# EAGLE board Resistor_Resistor (EAGLE 8.3.0), part 3 of 32 (continued)
## Placement (x,y rotation side) (continued)
R3281  10K  [0201]  44.86,50.04 0 top
R3282  10K  [0201]  44.86,50.65 0 top
R3283  10K  [0201]  44.86,51.26 0 top
R3284  10K  [0201]  44.86,51.87 0 top
R3285  10K  [0201]  44.86,52.48 0 top
R3286  10K  [0201]  44.86,53.09 0 top
R3287  10K  [0201]  44.86,53.7 0 top
R3288  10K  [0201]  44.86,54.31 0 top
R3289  10K  [0201]  44.86,54.91 0 top
R3290  10K  [0201]  44.86,55.52 0 top
R3291  10K  [0201]  44.86,56.13 0 top
R3292  10K  [0201]  44.86,56.74 0 top
R3293  10K  [0201]  44.86,57.35 0 top
R3294  10K  [0201]  44.86,57.96 0 top
R3295  10K  [0201]  44.86,58.57 0 top
R3296  10K  [0201]  44.86,59.18 0 top
R3297  10K  [0201]  44.86,59.79 0 top
R3298  10K  [0201]  44.86,60.4 0 top
R3299  10K  [0201]  44.86,61.01 0 top
R3300  10K  [0201]  44.86,61.62 0 top
R3301  10K  [0201]  44.86,62.23 0 top
R3302  10K  [0201]  44.86,62.84 0 top
R3303  10K  [0201]  44.86,63.45 0 top
R3304  10K  [0201]  44.86,64.06 0 top
R3305  10K  [0201]  44.86,64.67 0 top
R3306  10K  [0201]  44.86,65.28 0 top
R3307  10K  [0201]  44.86,65.89 0 top
R3308  10K  [0201]  44.86,66.5 0 top
R3309  10K  [0201]  44.86,67.11 0 top
R3310  10K  [0201]  44.86,67.72 0 top
R3311  10K  [0201]  44.86,68.33 0 top
R3312  10K  [0201]  44.86,68.94 0 top
R3313  10K  [0201]  44.86,69.55 0 top
R3314  10K  [0201]  44.86,70.15 0 top
R3315  10K  [0201]  44.86,70.76 0 top
R3316  10K  [0201]  44.86,71.37 0 top
R3317  10K  [0201]  44.86,71.98 0 top
R3318  10K  [0201]  44.86,72.59 0 top
R3319  10K  [0201]  44.86,73.2 0 top
R3320  10K  [0201]  44.86,73.81 0 top
R3321  10K  [0201]  44.86,74.42 0 top
R3322  10K  [0201]  44.86,75.03 0 top
R3323  10K  [0201]  44.86,75.64 0 top
R3324  10K  [0201]  44.86,76.25 0 top
R3325  10K  [0201]  44.86,76.86 0 top
R3326  10K  [0201]  44.86,77.47 0 top
R3327  10K  [0201]  44.86,78.08 0 top
R3328  10K  [0201]  44.86,78.69 0 top
R3329  10K  [0201]  44.86,79.3 0 top
R3330  10K  [0201]  44.86,79.91 0 top
R3331  10K  [0201]  44.86,80.52 0 top
R3332  10K  [0201]  44.86,81.13 0 top
R3333  10K  [0201]  44.86,81.74 0 top
R3334  10K  [0201]  44.86,82.35 0 top
R3335  10K  [0201]  44.86,82.96 0 top
R3336  10K  [0201]  44.86,83.57 0 top
R3337  10K  [0201]  44.86,84.18 0 top
R3338  10K  [0201]  44.86,84.79 0 top
R3339  10K  [0201]  44.86,85.39 0 top
R3340  10K  [0201]  44.86,86 0 top
R3341  10K  [0201]  44.86,86.61 0 top
R3342  10K  [0201]  44.86,87.22 0 top
R3343  10K  [0201]  44.86,87.83 0 top
R3344  10K  [0201]  44.86,88.44 0 top
R3345  10K  [0201]  44.86,89.05 0 top
R3346  10K  [0201]  44.86,89.66 0 top
R3347  10K  [0201]  44.86,90.27 0 top
R3348  10K  [0201]  44.86,90.88 0 top
R3349  10K  [0201]  44.86,91.49 0 top
R3350  10K  [0201]  44.86,92.1 0 top
R3351  10K  [0201]  44.86,92.71 0 top
R3352  10K  [0201]  44.86,93.32 0 top
R3353  10K  [0201]  44.86,93.93 0 top
R3354  10K  [0201]  44.86,94.54 0 top
R3355  10K  [0201]  44.86,95.15 0 top
R3356  10K  [0201]  44.86,95.76 0 top
R3357  10K  [0201]  44.86,96.37 0 top
R3358  10K  [0201]  44.86,96.98 0 top
R3359  10K  [0201]  44.86,97.59 0 top
R3360  10K  [0201]  44.86,98.2 0 top
R3361  10K  [0201]  44.86,98.81 0 top
R3362  10K  [0201]  44.86,99.42 0 top
R3363  10K  [0201]  44.86,100.03 0 top
R3364  10K  [0201]  44.86,100.63 0 top
R3365  10K  [0201]  44.86,101.24 0 top
R3366  10K  [0201]  44.86,101.85 0 top
R3367  10K  [0201]  44.86,102.46 0 top
R3368  10K  [0201]  44.86,103.07 0 top
R3369  10K  [0201]  44.86,103.68 0 top
R3370  10K  [0201]  44.86,104.29 0 top
R3371  10K  [0201]  44.86,104.9 0 top
R3372  10K  [0201]  44.86,105.51 0 top
R3373  10K  [0201]  44.86,106.12 0 top
R3374  10K  [0201]  44.86,106.73 0 top
R3375  10K  [0201]  44.86,107.34 0 top
R3376  10K  [0201]  44.86,107.95 0 top
R3377  10K  [0201]  44.86,108.56 0 top
R3378  10K  [0201]  44.86,109.17 0 top
R3379  10K  [0201]  44.86,109.78 0 top
R3380  10K  [0201]  44.86,110.39 0 top
R3381  10K  [0201]  44.86,111 0 top
R3382  10K  [0201]  44.86,111.61 0 top
R3383  10K  [0201]  44.86,112.22 0 top
R3384  10K  [0201]  44.86,112.83 0 top
R3385  10K  [0201]  44.86,113.44 0 top
R3386  10K  [0201]  44.86,114.05 0 top
R3387  10K  [0201]  44.86,114.66 0 top
R3388  10K  [0201]  44.86,115.27 0 top
R3389  10K  [0201]  44.86,115.87 0 top
R3390  10K  [0201]  44.86,116.48 0 top
R3391  10K  [0201]  44.86,117.09 0 top
R3392  10K  [0201]  44.86,117.7 0 top
R3393  10K  [0201]  44.86,118.31 0 top
R3394  10K  [0201]  44.86,118.92 0 top
R3395  10K  [0201]  44.86,119.53 0 top
R3396  10K  [0201]  44.86,120.14 0 top
R3397  10K  [0201]  44.86,120.75 0 top
R3398  10K  [0201]  44.86,121.36 0 top
R3399  10K  [0201]  44.86,121.97 0 top
R3400  10K  [0201]  44.86,122.58 0 top
R3401  10K  [0201]  46.08,1.27 0 top
R3402  10K  [0201]  46.08,1.88 0 top
R3403  10K  [0201]  46.08,2.49 0 top
R3404  10K  [0201]  46.08,3.1 0 top
R3405  10K  [0201]  46.08,3.71 0 top
R3406  10K  [0201]  46.08,4.32 0 top
R3407  10K  [0201]  46.08,4.93 0 top
R3408  10K  [0201]  46.08,5.54 0 top
R3409  10K  [0201]  46.08,6.15 0 top
R3410  10K  [0201]  46.08,6.76 0 top
R3411  10K  [0201]  46.08,7.37 0 top
R3412  10K  [0201]  46.08,7.98 0 top
R3413  10K  [0201]  46.08,8.59 0 top
R3414  10K  [0201]  46.08,9.19 0 top
R3415  10K  [0201]  46.08,9.8 0 top
R3416  10K  [0201]  46.08,10.41 0 top
R3417  10K  [0201]  46.08,11.02 0 top
R3418  10K  [0201]  46.08,11.63 0 top
R3419  10K  [0201]  46.08,12.24 0 top
R3420  10K  [0201]  46.08,12.85 0 top
R3421  10K  [0201]  46.08,13.46 0 top
R3422  10K  [0201]  46.08,14.07 0 top
R3423  10K  [0201]  46.08,14.68 0 top
R3424  10K  [0201]  46.08,15.29 0 top
R3425  10K  [0201]  46.08,15.9 0 top
R3426  10K  [0201]  46.08,16.51 0 top
R3427  10K  [0201]  46.08,17.12 0 top
R3428  10K  [0201]  46.08,17.73 0 top
R3429  10K  [0201]  46.08,18.34 0 top
R3430  10K  [0201]  46.08,18.95 0 top
R3431  10K  [0201]  46.08,19.56 0 top
R3432  10K  [0201]  46.08,20.17 0 top
R3433  10K  [0201]  46.08,20.78 0 top
R3434  10K  [0201]  46.08,21.39 0 top
R3435  10K  [0201]  46.08,22 0 top
R3436  10K  [0201]  46.08,22.61 0 top
R3437  10K  [0201]  46.08,23.22 0 top
R3438  10K  [0201]  46.08,23.83 0 top
R3439  10K  [0201]  46.08,24.43 0 top
R3440  10K  [0201]  46.08,25.04 0 top
R3441  10K  [0201]  46.08,25.65 0 top
R3442  10K  [0201]  46.08,26.26 0 top
R3443  10K  [0201]  46.08,26.87 0 top
R3444  10K  [0201]  46.08,27.48 0 top
R3445  10K  [0201]  46.08,28.09 0 top
R3446  10K  [0201]  46.08,28.7 0 top
R3447  10K  [0201]  46.08,29.31 0 top
R3448  10K  [0201]  46.08,29.92 0 top
R3449  10K  [0201]  46.08,30.53 0 top
R3450  10K  [0201]  46.08,31.14 0 top
R3451  10K  [0201]  46.08,31.75 0 top
R3452  10K  [0201]  46.08,32.36 0 top
R3453  10K  [0201]  46.08,32.97 0 top
R3454  10K  [0201]  46.08,33.58 0 top
R3455  10K  [0201]  46.08,34.19 0 top
R3456  10K  [0201]  46.08,34.8 0 top
R3457  10K  [0201]  46.08,35.41 0 top
R3458  10K  [0201]  46.08,36.02 0 top
R3459  10K  [0201]  46.08,36.63 0 top
R3460  10K  [0201]  46.08,37.24 0 top
R3461  10K  [0201]  46.08,37.85 0 top
R3462  10K  [0201]  46.08,38.46 0 top
R3463  10K  [0201]  46.08,39.07 0 top
R3464  10K  [0201]  46.08,39.67 0 top
R3465  10K  [0201]  46.08,40.28 0 top
R3466  10K  [0201]  46.08,40.89 0 top
R3467  10K  [0201]  46.08,41.5 0 top
R3468  10K  [0201]  46.08,42.11 0 top
R3469  10K  [0201]  46.08,42.72 0 top
R3470  10K  [0201]  46.08,43.33 0 top
R3471  10K  [0201]  46.08,43.94 0 top
R3472  10K  [0201]  46.08,44.55 0 top
R3473  10K  [0201]  46.08,45.16 0 top
R3474  10K  [0201]  46.08,45.77 0 top
R3475  10K  [0201]  46.08,46.38 0 top
R3476  10K  [0201]  46.08,46.99 0 top
R3477  10K  [0201]  46.08,47.6 0 top
R3478  10K  [0201]  46.08,48.21 0 top
R3479  10K  [0201]  46.08,48.82 0 top
R3480  10K  [0201]  46.08,49.43 0 top
R3481  10K  [0201]  46.08,50.04 0 top
R3482  10K  [0201]  46.08,50.65 0 top
R3483  10K  [0201]  46.08,51.26 0 top
R3484  10K  [0201]  46.08,51.87 0 top
R3485  10K  [0201]  46.08,52.48 0 top
R3486  10K  [0201]  46.08,53.09 0 top
R3487  10K  [0201]  46.08,53.7 0 top
R3488  10K  [0201]  46.08,54.31 0 top
R3489  10K  [0201]  46.08,54.91 0 top
R3490  10K  [0201]  46.08,55.52 0 top
R3491  10K  [0201]  46.08,56.13 0 top
R3492  10K  [0201]  46.08,56.74 0 top
R3493  10K  [0201]  46.08,57.35 0 top
R3494  10K  [0201]  46.08,57.96 0 top
R3495  10K  [0201]  46.08,58.57 0 top
R3496  10K  [0201]  46.08,59.18 0 top
R3497  10K  [0201]  46.08,59.79 0 top
R3498  10K  [0201]  46.08,60.4 0 top
R3499  10K  [0201]  46.08,61.01 0 top
R3500  10K  [0201]  46.08,61.62 0 top
R3501  10K  [0201]  46.08,62.23 0 top
R3502  10K  [0201]  46.08,62.84 0 top
R3503  10K  [0201]  46.08,63.45 0 top
R3504  10K  [0201]  46.08,64.06 0 top
R3505  10K  [0201]  46.08,64.67 0 top
R3506  10K  [0201]  46.08,65.28 0 top
R3507  10K  [0201]  46.08,65.89 0 top
R3508  10K  [0201]  46.08,66.5 0 top
R3509  10K  [0201]  46.08,67.11 0 top
R3510  10K  [0201]  46.08,67.72 0 top
R3511  10K  [0201]  46.08,68.33 0 top
R3512  10K  [0201]  46.08,68.94 0 top
R3513  10K  [0201]  46.08,69.55 0 top
R3514  10K  [0201]  46.08,70.15 0 top
R3515  10K  [0201]  46.08,70.76 0 top
R3516  10K  [0201]  46.08,71.37 0 top
R3517  10K  [0201]  46.08,71.98 0 top
R3518  10K  [0201]  46.08,72.59 0 top
R3519  10K  [0201]  46.08,73.2 0 top
R3520  10K  [0201]  46.08,73.81 0 top
R3521  10K  [0201]  46.08,74.42 0 top
R3522  10K  [0201]  46.08,75.03 0 top
R3523  10K  [0201]  46.08,75.64 0 top
R3524  10K  [0201]  46.08,76.25 0 top
R3525  10K  [0201]  46.08,76.86 0 top
R3526  10K  [0201]  46.08,77.47 0 top
R3527  10K  [0201]  46.08,78.08 0 top
R3528  10K  [0201]  46.08,78.69 0 top
R3529  10K  [0201]  46.08,79.3 0 top
R3530  10K  [0201]  46.08,79.91 0 top
R3531  10K  [0201]  46.08,80.52 0 top
R3532  10K  [0201]  46.08,81.13 0 top
R3533  10K  [0201]  46.08,81.74 0 top
R3534  10K  [0201]  46.08,82.35 0 top
R3535  10K  [0201]  46.08,82.96 0 top
R3536  10K  [0201]  46.08,83.57 0 top
R3537  10K  [0201]  46.08,84.18 0 top
R3538  10K  [0201]  46.08,84.79 0 top
R3539  10K  [0201]  46.08,85.39 0 top
R3540  10K  [0201]  46.08,86 0 top
R3541  10K  [0201]  46.08,86.61 0 top
R3542  10K  [0201]  46.08,87.22 0 top
R3543  10K  [0201]  46.08,87.83 0 top
R3544  10K  [0201]  46.08,88.44 0 top
R3545  10K  [0201]  46.08,89.05 0 top
R3546  10K  [0201]  46.08,89.66 0 top
R3547  10K  [0201]  46.08,90.27 0 top
R3548  10K  [0201]  46.08,90.88 0 top
R3549  10K  [0201]  46.08,91.49 0 top
R3550  10K  [0201]  46.08,92.1 0 top
R3551  10K  [0201]  46.08,92.71 0 top
R3552  10K  [0201]  46.08,93.32 0 top
R3553  10K  [0201]  46.08,93.93 0 top
R3554  10K  [0201]  46.08,94.54 0 top
R3555  10K  [0201]  46.08,95.15 0 top
R3556  10K  [0201]  46.08,95.76 0 top
R3557  10K  [0201]  46.08,96.37 0 top
R3558  10K  [0201]  46.08,96.98 0 top
R3559  10K  [0201]  46.08,97.59 0 top
R3560  10K  [0201]  46.08,98.2 0 top
R3561  10K  [0201]  46.08,98.81 0 top
R3562  10K  [0201]  46.08,99.42 0 top
R3563  10K  [0201]  46.08,100.03 0 top
R3564  10K  [0201]  46.08,100.63 0 top
R3565  10K  [0201]  46.08,101.24 0 top
R3566  10K  [0201]  46.08,101.85 0 top
R3567  10K  [0201]  46.08,102.46 0 top
R3568  10K  [0201]  46.08,103.07 0 top
R3569  10K  [0201]  46.08,103.68 0 top
R3570  10K  [0201]  46.08,104.29 0 top
R3571  10K  [0201]  46.08,104.9 0 top
R3572  10K  [0201]  46.08,105.51 0 top
R3573  10K  [0201]  46.08,106.12 0 top
R3574  10K  [0201]  46.08,106.73 0 top
R3575  10K  [0201]  46.08,107.34 0 top
R3576  10K  [0201]  46.08,107.95 0 top
R3577  10K  [0201]  46.08,108.56 0 top
R3578  10K  [0201]  46.08,109.17 0 top
R3579  10K  [0201]  46.08,109.78 0 top
R3580  10K  [0201]  46.08,110.39 0 top
R3581  10K  [0201]  46.08,111 0 top
R3582  10K  [0201]  46.08,111.61 0 top
R3583  10K  [0201]  46.08,112.22 0 top
R3584  10K  [0201]  46.08,112.83 0 top
R3585  10K  [0201]  46.08,113.44 0 top
R3586  10K  [0201]  46.08,114.05 0 top
R3587  10K  [0201]  46.08,114.66 0 top
R3588  10K  [0201]  46.08,115.27 0 top
R3589  10K  [0201]  46.08,115.87 0 top
R3590  10K  [0201]  46.08,116.48 0 top
R3591  10K  [0201]  46.08,117.09 0 top
R3592  10K  [0201]  46.08,117.7 0 top
R3593  10K  [0201]  46.08,118.31 0 top
R3594  10K  [0201]  46.08,118.92 0 top
R3595  10K  [0201]  46.08,119.53 0 top
R3596  10K  [0201]  46.08,120.14 0 top
R3597  10K  [0201]  46.08,120.75 0 top
R3598  10K  [0201]  46.08,121.36 0 top
R3599  10K  [0201]  46.08,121.97 0 top
R3600  10K  [0201]  46.08,122.58 0 top
R3601  10K  [0201]  47.29,1.27 0 top
R3602  10K  [0201]  47.29,1.88 0 top
R3603  10K  [0201]  47.29,2.49 0 top
R3604  10K  [0201]  47.29,3.1 0 top
R3605  10K  [0201]  47.29,3.71 0 top
R3606  10K  [0201]  47.29,4.32 0 top
R3607  10K  [0201]  47.29,4.93 0 top
R3608  10K  [0201]  47.29,5.54 0 top
R3609  10K  [0201]  47.29,6.15 0 top
R3610  10K  [0201]  47.29,6.76 0 top
R3611  10K  [0201]  47.29,7.37 0 top
R3612  10K  [0201]  47.29,7.98 0 top
R3613  10K  [0201]  47.29,8.59 0 top
R3614  10K  [0201]  47.29,9.19 0 top
R3615  10K  [0201]  47.29,9.8 0 top
R3616  10K  [0201]  47.29,10.41 0 top
R3617  10K  [0201]  47.29,11.02 0 top
R3618  10K  [0201]  47.29,11.63 0 top
R3619  10K  [0201]  47.29,12.24 0 top
R3620  10K  [0201]  47.29,12.85 0 top
R3621  10K  [0201]  47.29,13.46 0 top
R3622  10K  [0201]  47.29,14.07 0 top
R3623  10K  [0201]  47.29,14.68 0 top
R3624  10K  [0201]  47.29,15.29 0 top
R3625  10K  [0201]  47.29,15.9 0 top
R3626  10K  [0201]  47.29,16.51 0 top
R3627  10K  [0201]  47.29,17.12 0 top
R3628  10K  [0201]  47.29,17.73 0 top
R3629  10K  [0201]  47.29,18.34 0 top
R3630  10K  [0201]  47.29,18.95 0 top
R3631  10K  [0201]  47.29,19.56 0 top
R3632  10K  [0201]  47.29,20.17 0 top
R3633  10K  [0201]  47.29,20.78 0 top
R3634  10K  [0201]  47.29,21.39 0 top
R3635  10K  [0201]  47.29,22 0 top
R3636  10K  [0201]  47.29,22.61 0 top
R3637  10K  [0201]  47.29,23.22 0 top
R3638  10K  [0201]  47.29,23.83 0 top
R3639  10K  [0201]  47.29,24.43 0 top
R3640  10K  [0201]  47.29,25.04 0 top
R3641  10K  [0201]  47.29,25.65 0 top
R3642  10K  [0201]  47.29,26.26 0 top
R3643  10K  [0201]  47.29,26.87 0 top
R3644  10K  [0201]  47.29,27.48 0 top
R3645  10K  [0201]  47.29,28.09 0 top
R3646  10K  [0201]  47.29,28.7 0 top
R3647  10K  [0201]  47.29,29.31 0 top
R3648  10K  [0201]  47.29,29.92 0 top
R3649  10K  [0201]  47.29,30.53 0 top
R3650  10K  [0201]  47.29,31.14 0 top
R3651  10K  [0201]  47.29,31.75 0 top
R3652  10K  [0201]  47.29,32.36 0 top
R3653  10K  [0201]  47.29,32.97 0 top
R3654  10K  [0201]  47.29,33.58 0 top
R3655  10K  [0201]  47.29,34.19 0 top
R3656  10K  [0201]  47.29,34.8 0 top
R3657  10K  [0201]  47.29,35.41 0 top
R3658  10K  [0201]  47.29,36.02 0 top
R3659  10K  [0201]  47.29,36.63 0 top
R3660  10K  [0201]  47.29,37.24 0 top
R3661  10K  [0201]  47.29,37.85 0 top
R3662  10K  [0201]  47.29,38.46 0 top
R3663  10K  [0201]  47.29,39.07 0 top
R3664  10K  [0201]  47.29,39.67 0 top
R3665  10K  [0201]  47.29,40.28 0 top
R3666  10K  [0201]  47.29,40.89 0 top
R3667  10K  [0201]  47.29,41.5 0 top
R3668  10K  [0201]  47.29,42.11 0 top
R3669  10K  [0201]  47.29,42.72 0 top
R3670  10K  [0201]  47.29,43.33 0 top
R3671  10K  [0201]  47.29,43.94 0 top
R3672  10K  [0201]  47.29,44.55 0 top
R3673  10K  [0201]  47.29,45.16 0 top
R3674  10K  [0201]  47.29,45.77 0 top
R3675  10K  [0201]  47.29,46.38 0 top
R3676  10K  [0201]  47.29,46.99 0 top
R3677  10K  [0201]  47.29,47.6 0 top
R3678  10K  [0201]  47.29,48.21 0 top
R3679  10K  [0201]  47.29,48.82 0 top
R3680  10K  [0201]  47.29,49.43 0 top
R3681  10K  [0201]  47.29,50.04 0 top
R3682  10K  [0201]  47.29,50.65 0 top
R3683  10K  [0201]  47.29,51.26 0 top
R3684  10K  [0201]  47.29,51.87 0 top
R3685  10K  [0201]  47.29,52.48 0 top
R3686  10K  [0201]  47.29,53.09 0 top
R3687  10K  [0201]  47.29,53.7 0 top
R3688  10K  [0201]  47.29,54.31 0 top
R3689  10K  [0201]  47.29,54.91 0 top
R3690  10K  [0201]  47.29,55.52 0 top
R3691  10K  [0201]  47.29,56.13 0 top
R3692  10K  [0201]  47.29,56.74 0 top
R3693  10K  [0201]  47.29,57.35 0 top
R3694  10K  [0201]  47.29,57.96 0 top
R3695  10K  [0201]  47.29,58.57 0 top
R3696  10K  [0201]  47.29,59.18 0 top
R3697  10K  [0201]  47.29,59.79 0 top
R3698  10K  [0201]  47.29,60.4 0 top
R3699  10K  [0201]  47.29,61.01 0 top
R3700  10K  [0201]  47.29,61.62 0 top
R3701  10K  [0201]  47.29,62.23 0 top
R3702  10K  [0201]  47.29,62.84 0 top
R3703  10K  [0201]  47.29,63.45 0 top
R3704  10K  [0201]  47.29,64.06 0 top
R3705  10K  [0201]  47.29,64.67 0 top
R3706  10K  [0201]  47.29,65.28 0 top
R3707  10K  [0201]  47.29,65.89 0 top
R3708  10K  [0201]  47.29,66.5 0 top
R3709  10K  [0201]  47.29,67.11 0 top
R3710  10K  [0201]  47.29,67.72 0 top
R3711  10K  [0201]  47.29,68.33 0 top
R3712  10K  [0201]  47.29,68.94 0 top
R3713  10K  [0201]  47.29,69.55 0 top
R3714  10K  [0201]  47.29,70.15 0 top
R3715  10K  [0201]  47.29,70.76 0 top
R3716  10K  [0201]  47.29,71.37 0 top
R3717  10K  [0201]  47.29,71.98 0 top
R3718  10K  [0201]  47.29,72.59 0 top
R3719  10K  [0201]  47.29,73.2 0 top
R3720  10K  [0201]  47.29,73.81 0 top
R3721  10K  [0201]  47.29,74.42 0 top
R3722  10K  [0201]  47.29,75.03 0 top
R3723  10K  [0201]  47.29,75.64 0 top
R3724  10K  [0201]  47.29,76.25 0 top
R3725  10K  [0201]  47.29,76.86 0 top
R3726  10K  [0201]  47.29,77.47 0 top
R3727  10K  [0201]  47.29,78.08 0 top
R3728  10K  [0201]  47.29,78.69 0 top
R3729  10K  [0201]  47.29,79.3 0 top
R3730  10K  [0201]  47.29,79.91 0 top
R3731  10K  [0201]  47.29,80.52 0 top
R3732  10K  [0201]  47.29,81.13 0 top
R3733  10K  [0201]  47.29,81.74 0 top
R3734  10K  [0201]  47.29,82.35 0 top
R3735  10K  [0201]  47.29,82.96 0 top
R3736  10K  [0201]  47.29,83.57 0 top
R3737  10K  [0201]  47.29,84.18 0 top
R3738  10K  [0201]  47.29,84.79 0 top
R3739  10K  [0201]  47.29,85.39 0 top
R3740  10K  [0201]  47.29,86 0 top
R3741  10K  [0201]  47.29,86.61 0 top
R3742  10K  [0201]  47.29,87.22 0 top
R3743  10K  [0201]  47.29,87.83 0 top
R3744  10K  [0201]  47.29,88.44 0 top
R3745  10K  [0201]  47.29,89.05 0 top
R3746  10K  [0201]  47.29,89.66 0 top
R3747  10K  [0201]  47.29,90.27 0 top
R3748  10K  [0201]  47.29,90.88 0 top
R3749  10K  [0201]  47.29,91.49 0 top
R3750  10K  [0201]  47.29,92.1 0 top
R3751  10K  [0201]  47.29,92.71 0 top
R3752  10K  [0201]  47.29,93.32 0 top
R3753  10K  [0201]  47.29,93.93 0 top
R3754  10K  [0201]  47.29,94.54 0 top
R3755  10K  [0201]  47.29,95.15 0 top
R3756  10K  [0201]  47.29,95.76 0 top
R3757  10K  [0201]  47.29,96.37 0 top
R3758  10K  [0201]  47.29,96.98 0 top
R3759  10K  [0201]  47.29,97.59 0 top
R3760  10K  [0201]  47.29,98.2 0 top
R3761  10K  [0201]  47.29,98.81 0 top
R3762  10K  [0201]  47.29,99.42 0 top
R3763  10K  [0201]  47.29,100.03 0 top
R3764  10K  [0201]  47.29,100.63 0 top
R3765  10K  [0201]  47.29,101.24 0 top
R3766  10K  [0201]  47.29,101.85 0 top
R3767  10K  [0201]  47.29,102.46 0 top
R3768  10K  [0201]  47.29,103.07 0 top
R3769  10K  [0201]  47.29,103.68 0 top
R3770  10K  [0201]  47.29,104.29 0 top
R3771  10K  [0201]  47.29,104.9 0 top
R3772  10K  [0201]  47.29,105.51 0 top
R3773  10K  [0201]  47.29,106.12 0 top
R3774  10K  [0201]  47.29,106.73 0 top
R3775  10K  [0201]  47.29,107.34 0 top
R3776  10K  [0201]  47.29,107.95 0 top
R3777  10K  [0201]  47.29,108.56 0 top
R3778  10K  [0201]  47.29,109.17 0 top
R3779  10K  [0201]  47.29,109.78 0 top
R3780  10K  [0201]  47.29,110.39 0 top
R3781  10K  [0201]  47.29,111 0 top
R3782  10K  [0201]  47.29,111.61 0 top
R3783  10K  [0201]  47.29,112.22 0 top
R3784  10K  [0201]  47.29,112.83 0 top
R3785  10K  [0201]  47.29,113.44 0 top
R3786  10K  [0201]  47.29,114.05 0 top
R3787  10K  [0201]  47.29,114.66 0 top
R3788  10K  [0201]  47.29,115.27 0 top
R3789  10K  [0201]  47.29,115.87 0 top
R3790  10K  [0201]  47.29,116.48 0 top
R3791  10K  [0201]  47.29,117.09 0 top
R3792  10K  [0201]  47.29,117.7 0 top
R3793  10K  [0201]  47.29,118.31 0 top
R3794  10K  [0201]  47.29,118.92 0 top
R3795  10K  [0201]  47.29,119.53 0 top
R3796  10K  [0201]  47.29,120.14 0 top
R3797  10K  [0201]  47.29,120.75 0 top
R3798  10K  [0201]  47.29,121.36 0 top
R3799  10K  [0201]  47.29,121.97 0 top
R3800  10K  [0201]  47.29,122.58 0 top
R3801  10K  [0201]  48.51,1.27 0 top
R3802  10K  [0201]  48.51,1.88 0 top
R3803  10K  [0201]  48.51,2.49 0 top
R3804  10K  [0201]  48.51,3.1 0 top
R3805  10K  [0201]  48.51,3.71 0 top
R3806  10K  [0201]  48.51,4.32 0 top
R3807  10K  [0201]  48.51,4.93 0 top
R3808  10K  [0201]  48.51,5.54 0 top
R3809  10K  [0201]  48.51,6.15 0 top
R3810  10K  [0201]  48.51,6.76 0 top
R3811  10K  [0201]  48.51,7.37 0 top
R3812  10K  [0201]  48.51,7.98 0 top
R3813  10K  [0201]  48.51,8.59 0 top
R3814  10K  [0201]  48.51,9.19 0 top
R3815  10K  [0201]  48.51,9.8 0 top
R3816  10K  [0201]  48.51,10.41 0 top
R3817  10K  [0201]  48.51,11.02 0 top
R3818  10K  [0201]  48.51,11.63 0 top
R3819  10K  [0201]  48.51,12.24 0 top
R3820  10K  [0201]  48.51,12.85 0 top
R3821  10K  [0201]  48.51,13.46 0 top
R3822  10K  [0201]  48.51,14.07 0 top
R3823  10K  [0201]  48.51,14.68 0 top
R3824  10K  [0201]  48.51,15.29 0 top
R3825  10K  [0201]  48.51,15.9 0 top
R3826  10K  [0201]  48.51,16.51 0 top
R3827  10K  [0201]  48.51,17.12 0 top
R3828  10K  [0201]  48.51,17.73 0 top
R3829  10K  [0201]  48.51,18.34 0 top
R3830  10K  [0201]  48.51,18.95 0 top
R3831  10K  [0201]  48.51,19.56 0 top
R3832  10K  [0201]  48.51,20.17 0 top
R3833  10K  [0201]  48.51,20.78 0 top
R3834  10K  [0201]  48.51,21.39 0 top
R3835  10K  [0201]  48.51,22 0 top
R3836  10K  [0201]  48.51,22.61 0 top
R3837  10K  [0201]  48.51,23.22 0 top
R3838  10K  [0201]  48.51,23.83 0 top
R3839  10K  [0201]  48.51,24.43 0 top
R3840  10K  [0201]  48.51,25.04 0 top
R3841  10K  [0201]  48.51,25.65 0 top
R3842  10K  [0201]  48.51,26.26 0 top
R3843  10K  [0201]  48.51,26.87 0 top
R3844  10K  [0201]  48.51,27.48 0 top
R3845  10K  [0201]  48.51,28.09 0 top
R3846  10K  [0201]  48.51,28.7 0 top
R3847  10K  [0201]  48.51,29.31 0 top
R3848  10K  [0201]  48.51,29.92 0 top
R3849  10K  [0201]  48.51,30.53 0 top
R3850  10K  [0201]  48.51,31.14 0 top
R3851  10K  [0201]  48.51,31.75 0 top
R3852  10K  [0201]  48.51,32.36 0 top
R3853  10K  [0201]  48.51,32.97 0 top
R3854  10K  [0201]  48.51,33.58 0 top
R3855  10K  [0201]  48.51,34.19 0 top
R3856  10K  [0201]  48.51,34.8 0 top
R3857  10K  [0201]  48.51,35.41 0 top
R3858  10K  [0201]  48.51,36.02 0 top
R3859  10K  [0201]  48.51,36.63 0 top
R3860  10K  [0201]  48.51,37.24 0 top
R3861  10K  [0201]  48.51,37.85 0 top
R3862  10K  [0201]  48.51,38.46 0 top
R3863  10K  [0201]  48.51,39.07 0 top
R3864  10K  [0201]  48.51,39.67 0 top
R3865  10K  [0201]  48.51,40.28 0 top
R3866  10K  [0201]  48.51,40.89 0 top
R3867  10K  [0201]  48.51,41.5 0 top
R3868  10K  [0201]  48.51,42.11 0 top
R3869  10K  [0201]  48.51,42.72 0 top
R3870  10K  [0201]  48.51,43.33 0 top
R3871  10K  [0201]  48.51,43.94 0 top
R3872  10K  [0201]  48.51,44.55 0 top
R3873  10K  [0201]  48.51,45.16 0 top
R3874  10K  [0201]  48.51,45.77 0 top
R3875  10K  [0201]  48.51,46.38 0 top
R3876  10K  [0201]  48.51,46.99 0 top
R3877  10K  [0201]  48.51,47.6 0 top
R3878  10K  [0201]  48.51,48.21 0 top
R3879  10K  [0201]  48.51,48.82 0 top
R3880  10K  [0201]  48.51,49.43 0 top
R3881  10K  [0201]  48.51,50.04 0 top
R3882  10K  [0201]  48.51,50.65 0 top
R3883  10K  [0201]  48.51,51.26 0 top
R3884  10K  [0201]  48.51,51.87 0 top
R3885  10K  [0201]  48.51,52.48 0 top
R3886  10K  [0201]  48.51,53.09 0 top
R3887  10K  [0201]  48.51,53.7 0 top
R3888  10K  [0201]  48.51,54.31 0 top
R3889  10K  [0201]  48.51,54.91 0 top
R3890  10K  [0201]  48.51,55.52 0 top
R3891  10K  [0201]  48.51,56.13 0 top
R3892  10K  [0201]  48.51,56.74 0 top
R3893  10K  [0201]  48.51,57.35 0 top
R3894  10K  [0201]  48.51,57.96 0 top
R3895  10K  [0201]  48.51,58.57 0 top
R3896  10K  [0201]  48.51,59.18 0 top
R3897  10K  [0201]  48.51,59.79 0 top
R3898  10K  [0201]  48.51,60.4 0 top
R3899  10K  [0201]  48.51,61.01 0 top
R3900  10K  [0201]  48.51,61.62 0 top
R3901  10K  [0201]  48.51,62.23 0 top
R3902  10K  [0201]  48.51,62.84 0 top
R3903  10K  [0201]  48.51,63.45 0 top
R3904  10K  [0201]  48.51,64.06 0 top
R3905  10K  [0201]  48.51,64.67 0 top
R3906  10K  [0201]  48.51,65.28 0 top
R3907  10K  [0201]  48.51,65.89 0 top
R3908  10K  [0201]  48.51,66.5 0 top
R3909  10K  [0201]  48.51,67.11 0 top
R3910  10K  [0201]  48.51,67.72 0 top
R3911  10K  [0201]  48.51,68.33 0 top
R3912  10K  [0201]  48.51,68.94 0 top
R3913  10K  [0201]  48.51,69.55 0 top
R3914  10K  [0201]  48.51,70.15 0 top
R3915  10K  [0201]  48.51,70.76 0 top
R3916  10K  [0201]  48.51,71.37 0 top
R3917  10K  [0201]  48.51,71.98 0 top
R3918  10K  [0201]  48.51,72.59 0 top
R3919  10K  [0201]  48.51,73.2 0 top
R3920  10K  [0201]  48.51,73.81 0 top
R3921  10K  [0201]  48.51,74.42 0 top
R3922  10K  [0201]  48.51,75.03 0 top
R3923  10K  [0201]  48.51,75.64 0 top
R3924  10K  [0201]  48.51,76.25 0 top
R3925  10K  [0201]  48.51,76.86 0 top
R3926  10K  [0201]  48.51,77.47 0 top
R3927  10K  [0201]  48.51,78.08 0 top
R3928  10K  [0201]  48.51,78.69 0 top
R3929  10K  [0201]  48.51,79.3 0 top
R3930  10K  [0201]  48.51,79.91 0 top
R3931  10K  [0201]  48.51,80.52 0 top
R3932  10K  [0201]  48.51,81.13 0 top
R3933  10K  [0201]  48.51,81.74 0 top
R3934  10K  [0201]  48.51,82.35 0 top
R3935  10K  [0201]  48.51,82.96 0 top